# EAGLE board Resistor_Resistor (EAGLE 8.3.0), part 13 of 32
## Placement (x,y rotation side) (continued)
R15499  10K  [0201]  119.23,61.01 0 top
R15500  10K  [0201]  119.23,61.62 0 top
R15501  10K  [0201]  119.23,62.23 0 top
R15502  10K  [0201]  119.23,62.84 0 top
R15503  10K  [0201]  119.23,63.45 0 top
R15504  10K  [0201]  119.23,64.06 0 top
R15505  10K  [0201]  119.23,64.67 0 top
R15506  10K  [0201]  119.23,65.28 0 top
R15507  10K  [0201]  119.23,65.89 0 top
R15508  10K  [0201]  119.23,66.5 0 top
R15509  10K  [0201]  119.23,67.11 0 top
R15510  10K  [0201]  119.23,67.72 0 top
R15511  10K  [0201]  119.23,68.33 0 top
R15512  10K  [0201]  119.23,68.94 0 top
R15513  10K  [0201]  119.23,69.55 0 top
R15514  10K  [0201]  119.23,70.15 0 top
R15515  10K  [0201]  119.23,70.76 0 top
R15516  10K  [0201]  119.23,71.37 0 top
R15517  10K  [0201]  119.23,71.98 0 top
R15518  10K  [0201]  119.23,72.59 0 top
R15519  10K  [0201]  119.23,73.2 0 top
R15520  10K  [0201]  119.23,73.81 0 top
R15521  10K  [0201]  119.23,74.42 0 top
R15522  10K  [0201]  119.23,75.03 0 top
R15523  10K  [0201]  119.23,75.64 0 top
R15524  10K  [0201]  119.23,76.25 0 top
R15525  10K  [0201]  119.23,76.86 0 top
R15526  10K  [0201]  119.23,77.47 0 top
R15527  10K  [0201]  119.23,78.08 0 top
R15528  10K  [0201]  119.23,78.69 0 top
R15529  10K  [0201]  119.23,79.3 0 top
R15530  10K  [0201]  119.23,79.91 0 top
R15531  10K  [0201]  119.23,80.52 0 top
R15532  10K  [0201]  119.23,81.13 0 top
R15533  10K  [0201]  119.23,81.74 0 top
R15534  10K  [0201]  119.23,82.35 0 top
R15535  10K  [0201]  119.23,82.96 0 top
R15536  10K  [0201]  119.23,83.57 0 top
R15537  10K  [0201]  119.23,84.18 0 top
R15538  10K  [0201]  119.23,84.79 0 top
R15539  10K  [0201]  119.23,85.39 0 top
R15540  10K  [0201]  119.23,86 0 top
R15541  10K  [0201]  119.23,86.61 0 top
R15542  10K  [0201]  119.23,87.22 0 top
R15543  10K  [0201]  119.23,87.83 0 top
R15544  10K  [0201]  119.23,88.44 0 top
R15545  10K  [0201]  119.23,89.05 0 top
R15546  10K  [0201]  119.23,89.66 0 top
R15547  10K  [0201]  119.23,90.27 0 top
R15548  10K  [0201]  119.23,90.88 0 top
R15549  10K  [0201]  119.23,91.49 0 top
R15550  10K  [0201]  119.23,92.1 0 top
R15551  10K  [0201]  119.23,92.71 0 top
R15552  10K  [0201]  119.23,93.32 0 top
R15553  10K  [0201]  119.23,93.93 0 top
R15554  10K  [0201]  119.23,94.54 0 top
R15555  10K  [0201]  119.23,95.15 0 top
R15556  10K  [0201]  119.23,95.76 0 top
R15557  10K  [0201]  119.23,96.37 0 top
R15558  10K  [0201]  119.23,96.98 0 top
R15559  10K  [0201]  119.23,97.59 0 top
R15560  10K  [0201]  119.23,98.2 0 top
R15561  10K  [0201]  119.23,98.81 0 top
R15562  10K  [0201]  119.23,99.42 0 top
R15563  10K  [0201]  119.23,100.03 0 top
R15564  10K  [0201]  119.23,100.63 0 top
R15565  10K  [0201]  119.23,101.24 0 top
R15566  10K  [0201]  119.23,101.85 0 top
R15567  10K  [0201]  119.23,102.46 0 top
R15568  10K  [0201]  119.23,103.07 0 top
R15569  10K  [0201]  119.23,103.68 0 top
R15570  10K  [0201]  119.23,104.29 0 top
R15571  10K  [0201]  119.23,104.9 0 top
R15572  10K  [0201]  119.23,105.51 0 top
R15573  10K  [0201]  119.23,106.12 0 top
R15574  10K  [0201]  119.23,106.73 0 top
R15575  10K  [0201]  119.23,107.34 0 top
R15576  10K  [0201]  119.23,107.95 0 top
R15577  10K  [0201]  119.23,108.56 0 top
R15578  10K  [0201]  119.23,109.17 0 top
R15579  10K  [0201]  119.23,109.78 0 top
R15580  10K  [0201]  119.23,110.39 0 top
R15581  10K  [0201]  119.23,111 0 top
R15582  10K  [0201]  119.23,111.61 0 top
R15583  10K  [0201]  119.23,112.22 0 top
R15584  10K  [0201]  119.23,112.83 0 top
R15585  10K  [0201]  119.23,113.44 0 top
R15586  10K  [0201]  119.23,114.05 0 top
R15587  10K  [0201]  119.23,114.66 0 top
R15588  10K  [0201]  119.23,115.27 0 top
R15589  10K  [0201]  119.23,115.87 0 top
R15590  10K  [0201]  119.23,116.48 0 top
R15591  10K  [0201]  119.23,117.09 0 top
R15592  10K  [0201]  119.23,117.7 0 top
R15593  10K  [0201]  119.23,118.31 0 top
R15594  10K  [0201]  119.23,118.92 0 top
R15595  10K  [0201]  119.23,119.53 0 top
R15596  10K  [0201]  119.23,120.14 0 top
R15597  10K  [0201]  119.23,120.75 0 top
R15598  10K  [0201]  119.23,121.36 0 top
R15599  10K  [0201]  119.23,121.97 0 top
R15600  10K  [0201]  119.23,122.58 0 top
R15601  10K  [0201]  120.45,1.27 0 top
R15602  10K  [0201]  120.45,1.88 0 top
R15603  10K  [0201]  120.45,2.49 0 top
R15604  10K  [0201]  120.45,3.1 0 top
R15605  10K  [0201]  120.45,3.71 0 top
R15606  10K  [0201]  120.45,4.32 0 top
R15607  10K  [0201]  120.45,4.93 0 top
R15608  10K  [0201]  120.45,5.54 0 top
R15609  10K  [0201]  120.45,6.15 0 top
R15610  10K  [0201]  120.45,6.76 0 top
R15611  10K  [0201]  120.45,7.37 0 top
R15612  10K  [0201]  120.45,7.98 0 top
R15613  10K  [0201]  120.45,8.59 0 top
R15614  10K  [0201]  120.45,9.19 0 top
R15615  10K  [0201]  120.45,9.8 0 top
R15616  10K  [0201]  120.45,10.41 0 top
R15617  10K  [0201]  120.45,11.02 0 top
R15618  10K  [0201]  120.45,11.63 0 top
R15619  10K  [0201]  120.45,12.24 0 top
R15620  10K  [0201]  120.45,12.85 0 top
R15621  10K  [0201]  120.45,13.46 0 top
R15622  10K  [0201]  120.45,14.07 0 top
R15623  10K  [0201]  120.45,14.68 0 top
R15624  10K  [0201]  120.45,15.29 0 top
R15625  10K  [0201]  120.45,15.9 0 top
R15626  10K  [0201]  120.45,16.51 0 top
R15627  10K  [0201]  120.45,17.12 0 top
R15628  10K  [0201]  120.45,17.73 0 top
R15629  10K  [0201]  120.45,18.34 0 top
R15630  10K  [0201]  120.45,18.95 0 top
R15631  10K  [0201]  120.45,19.56 0 top
R15632  10K  [0201]  120.45,20.17 0 top
R15633  10K  [0201]  120.45,20.78 0 top
R15634  10K  [0201]  120.45,21.39 0 top
R15635  10K  [0201]  120.45,22 0 top
R15636  10K  [0201]  120.45,22.61 0 top
R15637  10K  [0201]  120.45,23.22 0 top
R15638  10K  [0201]  120.45,23.83 0 top
R15639  10K  [0201]  120.45,24.43 0 top
R15640  10K  [0201]  120.45,25.04 0 top
R15641  10K  [0201]  120.45,25.65 0 top
R15642  10K  [0201]  120.45,26.26 0 top
R15643  10K  [0201]  120.45,26.87 0 top
R15644  10K  [0201]  120.45,27.48 0 top
R15645  10K  [0201]  120.45,28.09 0 top
R15646  10K  [0201]  120.45,28.7 0 top
R15647  10K  [0201]  120.45,29.31 0 top
R15648  10K  [0201]  120.45,29.92 0 top
R15649  10K  [0201]  120.45,30.53 0 top
R15650  10K  [0201]  120.45,31.14 0 top
R15651  10K  [0201]  120.45,31.75 0 top
R15652  10K  [0201]  120.45,32.36 0 top
R15653  10K  [0201]  120.45,32.97 0 top
R15654  10K  [0201]  120.45,33.58 0 top
R15655  10K  [0201]  120.45,34.19 0 top
R15656  10K  [0201]  120.45,34.8 0 top
R15657  10K  [0201]  120.45,35.41 0 top
R15658  10K  [0201]  120.45,36.02 0 top
R15659  10K  [0201]  120.45,36.63 0 top
R15660  10K  [0201]  120.45,37.24 0 top
R15661  10K  [0201]  120.45,37.85 0 top
R15662  10K  [0201]  120.45,38.46 0 top
R15663  10K  [0201]  120.45,39.07 0 top
R15664  10K  [0201]  120.45,39.67 0 top
R15665  10K  [0201]  120.45,40.28 0 top
R15666  10K  [0201]  120.45,40.89 0 top
R15667  10K  [0201]  120.45,41.5 0 top
R15668  10K  [0201]  120.45,42.11 0 top
R15669  10K  [0201]  120.45,42.72 0 top
R15670  10K  [0201]  120.45,43.33 0 top
R15671  10K  [0201]  120.45,43.94 0 top
R15672  10K  [0201]  120.45,44.55 0 top
R15673  10K  [0201]  120.45,45.16 0 top
R15674  10K  [0201]  120.45,45.77 0 top
R15675  10K  [0201]  120.45,46.38 0 top
R15676  10K  [0201]  120.45,46.99 0 top
R15677  10K  [0201]  120.45,47.6 0 top
R15678  10K  [0201]  120.45,48.21 0 top
R15679  10K  [0201]  120.45,48.82 0 top
R15680  10K  [0201]  120.45,49.43 0 top
R15681  10K  [0201]  120.45,50.04 0 top
R15682  10K  [0201]  120.45,50.65 0 top
R15683  10K  [0201]  120.45,51.26 0 top
R15684  10K  [0201]  120.45,51.87 0 top
R15685  10K  [0201]  120.45,52.48 0 top
R15686  10K  [0201]  120.45,53.09 0 top
R15687  10K  [0201]  120.45,53.7 0 top
R15688  10K  [0201]  120.45,54.31 0 top
R15689  10K  [0201]  120.45,54.91 0 top
R15690  10K  [0201]  120.45,55.52 0 top
R15691  10K  [0201]  120.45,56.13 0 top
R15692  10K  [0201]  120.45,56.74 0 top
R15693  10K  [0201]  120.45,57.35 0 top
R15694  10K  [0201]  120.45,57.96 0 top
R15695  10K  [0201]  120.45,58.57 0 top
R15696  10K  [0201]  120.45,59.18 0 top
R15697  10K  [0201]  120.45,59.79 0 top
R15698  10K  [0201]  120.45,60.4 0 top
R15699  10K  [0201]  120.45,61.01 0 top
R15700  10K  [0201]  120.45,61.62 0 top
R15701  10K  [0201]  120.45,62.23 0 top
R15702  10K  [0201]  120.45,62.84 0 top
R15703  10K  [0201]  120.45,63.45 0 top
R15704  10K  [0201]  120.45,64.06 0 top
R15705  10K  [0201]  120.45,64.67 0 top
R15706  10K  [0201]  120.45,65.28 0 top
R15707  10K  [0201]  120.45,65.89 0 top
R15708  10K  [0201]  120.45,66.5 0 top
R15709  10K  [0201]  120.45,67.11 0 top
R15710  10K  [0201]  120.45,67.72 0 top
R15711  10K  [0201]  120.45,68.33 0 top
R15712  10K  [0201]  120.45,68.94 0 top
R15713  10K  [0201]  120.45,69.55 0 top
R15714  10K  [0201]  120.45,70.15 0 top
R15715  10K  [0201]  120.45,70.76 0 top
R15716  10K  [0201]  120.45,71.37 0 top
R15717  10K  [0201]  120.45,71.98 0 top
R15718  10K  [0201]  120.45,72.59 0 top
R15719  10K  [0201]  120.45,73.2 0 top
R15720  10K  [0201]  120.45,73.81 0 top
R15721  10K  [0201]  120.45,74.42 0 top
R15722  10K  [0201]  120.45,75.03 0 top
R15723  10K  [0201]  120.45,75.64 0 top
R15724  10K  [0201]  120.45,76.25 0 top
R15725  10K  [0201]  120.45,76.86 0 top
R15726  10K  [0201]  120.45,77.47 0 top
R15727  10K  [0201]  120.45,78.08 0 top
R15728  10K  [0201]  120.45,78.69 0 top
R15729  10K  [0201]  120.45,79.3 0 top
R15730  10K  [0201]  120.45,79.91 0 top
R15731  10K  [0201]  120.45,80.52 0 top
R15732  10K  [0201]  120.45,81.13 0 top
R15733  10K  [0201]  120.45,81.74 0 top
R15734  10K  [0201]  120.45,82.35 0 top
R15735  10K  [0201]  120.45,82.96 0 top
R15736  10K  [0201]  120.45,83.57 0 top
R15737  10K  [0201]  120.45,84.18 0 top
R15738  10K  [0201]  120.45,84.79 0 top
R15739  10K  [0201]  120.45,85.39 0 top
R15740  10K  [0201]  120.45,86 0 top
R15741  10K  [0201]  120.45,86.61 0 top
R15742  10K  [0201]  120.45,87.22 0 top
R15743  10K  [0201]  120.45,87.83 0 top
R15744  10K  [0201]  120.45,88.44 0 top
R15745  10K  [0201]  120.45,89.05 0 top
R15746  10K  [0201]  120.45,89.66 0 top
R15747  10K  [0201]  120.45,90.27 0 top
R15748  10K  [0201]  120.45,90.88 0 top
R15749  10K  [0201]  120.45,91.49 0 top
R15750  10K  [0201]  120.45,92.1 0 top
R15751  10K  [0201]  120.45,92.71 0 top
R15752  10K  [0201]  120.45,93.32 0 top
R15753  10K  [0201]  120.45,93.93 0 top
R15754  10K  [0201]  120.45,94.54 0 top
R15755  10K  [0201]  120.45,95.15 0 top
R15756  10K  [0201]  120.45,95.76 0 top
R15757  10K  [0201]  120.45,96.37 0 top
R15758  10K  [0201]  120.45,96.98 0 top
R15759  10K  [0201]  120.45,97.59 0 top
R15760  10K  [0201]  120.45,98.2 0 top
R15761  10K  [0201]  120.45,98.81 0 top
R15762  10K  [0201]  120.45,99.42 0 top
R15763  10K  [0201]  120.45,100.03 0 top
R15764  10K  [0201]  120.45,100.63 0 top
R15765  10K  [0201]  120.45,101.24 0 top
R15766  10K  [0201]  120.45,101.85 0 top
R15767  10K  [0201]  120.45,102.46 0 top
R15768  10K  [0201]  120.45,103.07 0 top
R15769  10K  [0201]  120.45,103.68 0 top
R15770  10K  [0201]  120.45,104.29 0 top
R15771  10K  [0201]  120.45,104.9 0 top
R15772  10K  [0201]  120.45,105.51 0 top
R15773  10K  [0201]  120.45,106.12 0 top
R15774  10K  [0201]  120.45,106.73 0 top
R15775  10K  [0201]  120.45,107.34 0 top
R15776  10K  [0201]  120.45,107.95 0 top
R15777  10K  [0201]  120.45,108.56 0 top
R15778  10K  [0201]  120.45,109.17 0 top
R15779  10K  [0201]  120.45,109.78 0 top
R15780  10K  [0201]  120.45,110.39 0 top
R15781  10K  [0201]  120.45,111 0 top
R15782  10K  [0201]  120.45,111.61 0 top
R15783  10K  [0201]  120.45,112.22 0 top
R15784  10K  [0201]  120.45,112.83 0 top
R15785  10K  [0201]  120.45,113.44 0 top
R15786  10K  [0201]  120.45,114.05 0 top
R15787  10K  [0201]  120.45,114.66 0 top
R15788  10K  [0201]  120.45,115.27 0 top
R15789  10K  [0201]  120.45,115.87 0 top
R15790  10K  [0201]  120.45,116.48 0 top
R15791  10K  [0201]  120.45,117.09 0 top
R15792  10K  [0201]  120.45,117.7 0 top
R15793  10K  [0201]  120.45,118.31 0 top
R15794  10K  [0201]  120.45,118.92 0 top
R15795  10K  [0201]  120.45,119.53 0 top
R15796  10K  [0201]  120.45,120.14 0 top
R15797  10K  [0201]  120.45,120.75 0 top
R15798  10K  [0201]  120.45,121.36 0 top
R15799  10K  [0201]  120.45,121.97 0 top
R15800  10K  [0201]  120.45,122.58 0 top
R15801  10K  [0201]  121.67,1.27 0 top
R15802  10K  [0201]  121.67,1.88 0 top
R15803  10K  [0201]  121.67,2.49 0 top
R15804  10K  [0201]  121.67,3.1 0 top
R15805  10K  [0201]  121.67,3.71 0 top
R15806  10K  [0201]  121.67,4.32 0 top
R15807  10K  [0201]  121.67,4.93 0 top
R15808  10K  [0201]  121.67,5.54 0 top
R15809  10K  [0201]  121.67,6.15 0 top
R15810  10K  [0201]  121.67,6.76 0 top
R15811  10K  [0201]  121.67,7.37 0 top
R15812  10K  [0201]  121.67,7.98 0 top
R15813  10K  [0201]  121.67,8.59 0 top
R15814  10K  [0201]  121.67,9.19 0 top
R15815  10K  [0201]  121.67,9.8 0 top
R15816  10K  [0201]  121.67,10.41 0 top
R15817  10K  [0201]  121.67,11.02 0 top
R15818  10K  [0201]  121.67,11.63 0 top
R15819  10K  [0201]  121.67,12.24 0 top
R15820  10K  [0201]  121.67,12.85 0 top
R15821  10K  [0201]  121.67,13.46 0 top
R15822  10K  [0201]  121.67,14.07 0 top
R15823  10K  [0201]  121.67,14.68 0 top
R15824  10K  [0201]  121.67,15.29 0 top
R15825  10K  [0201]  121.67,15.9 0 top
R15826  10K  [0201]  121.67,16.51 0 top
R15827  10K  [0201]  121.67,17.12 0 top
R15828  10K  [0201]  121.67,17.73 0 top
R15829  10K  [0201]  121.67,18.34 0 top
R15830  10K  [0201]  121.67,18.95 0 top
R15831  10K  [0201]  121.67,19.56 0 top
R15832  10K  [0201]  121.67,20.17 0 top
R15833  10K  [0201]  121.67,20.78 0 top
R15834  10K  [0201]  121.67,21.39 0 top
R15835  10K  [0201]  121.67,22 0 top
R15836  10K  [0201]  121.67,22.61 0 top
R15837  10K  [0201]  121.67,23.22 0 top
R15838  10K  [0201]  121.67,23.83 0 top
R15839  10K  [0201]  121.67,24.43 0 top
R15840  10K  [0201]  121.67,25.04 0 top
R15841  10K  [0201]  121.67,25.65 0 top
R15842  10K  [0201]  121.67,26.26 0 top
R15843  10K  [0201]  121.67,26.87 0 top
R15844  10K  [0201]  121.67,27.48 0 top
R15845  10K  [0201]  121.67,28.09 0 top
R15846  10K  [0201]  121.67,28.7 0 top
R15847  10K  [0201]  121.67,29.31 0 top
R15848  10K  [0201]  121.67,29.92 0 top
R15849  10K  [0201]  121.67,30.53 0 top
R15850  10K  [0201]  121.67,31.14 0 top
R15851  10K  [0201]  121.67,31.75 0 top
R15852  10K  [0201]  121.67,32.36 0 top
R15853  10K  [0201]  121.67,32.97 0 top
R15854  10K  [0201]  121.67,33.58 0 top
R15855  10K  [0201]  121.67,34.19 0 top
R15856  10K  [0201]  121.67,34.8 0 top
R15857  10K  [0201]  121.67,35.41 0 top
R15858  10K  [0201]  121.67,36.02 0 top
R15859  10K  [0201]  121.67,36.63 0 top
R15860  10K  [0201]  121.67,37.24 0 top
R15861  10K  [0201]  121.67,37.85 0 top
R15862  10K  [0201]  121.67,38.46 0 top
R15863  10K  [0201]  121.67,39.07 0 top
R15864  10K  [0201]  121.67,39.67 0 top
R15865  10K  [0201]  121.67,40.28 0 top
R15866  10K  [0201]  121.67,40.89 0 top
R15867  10K  [0201]  121.67,41.5 0 top
R15868  10K  [0201]  121.67,42.11 0 top
R15869  10K  [0201]  121.67,42.72 0 top
R15870  10K  [0201]  121.67,43.33 0 top
R15871  10K  [0201]  121.67,43.94 0 top
R15872  10K  [0201]  121.67,44.55 0 top
R15873  10K  [0201]  121.67,45.16 0 top
R15874  10K  [0201]  121.67,45.77 0 top
R15875  10K  [0201]  121.67,46.38 0 top
R15876  10K  [0201]  121.67,46.99 0 top
R15877  10K  [0201]  121.67,47.6 0 top
R15878  10K  [0201]  121.67,48.21 0 top
R15879  10K  [0201]  121.67,48.82 0 top
R15880  10K  [0201]  121.67,49.43 0 top
R15881  10K  [0201]  121.67,50.04 0 top
R15882  10K  [0201]  121.67,50.65 0 top
R15883  10K  [0201]  121.67,51.26 0 top
R15884  10K  [0201]  121.67,51.87 0 top
R15885  10K  [0201]  121.67,52.48 0 top
R15886  10K  [0201]  121.67,53.09 0 top
R15887  10K  [0201]  121.67,53.7 0 top
R15888  10K  [0201]  121.67,54.31 0 top
R15889  10K  [0201]  121.67,54.91 0 top
R15890  10K  [0201]  121.67,55.52 0 top
R15891  10K  [0201]  121.67,56.13 0 top
R15892  10K  [0201]  121.67,56.74 0 top
R15893  10K  [0201]  121.67,57.35 0 top
R15894  10K  [0201]  121.67,57.96 0 top
R15895  10K  [0201]  121.67,58.57 0 top
R15896  10K  [0201]  121.67,59.18 0 top
R15897  10K  [0201]  121.67,59.79 0 top
R15898  10K  [0201]  121.67,60.4 0 top
R15899  10K  [0201]  121.67,61.01 0 top
R15900  10K  [0201]  121.67,61.62 0 top
R15901  10K  [0201]  121.67,62.23 0 top
R15902  10K  [0201]  121.67,62.84 0 top
R15903  10K  [0201]  121.67,63.45 0 top
R15904  10K  [0201]  121.67,64.06 0 top
R15905  10K  [0201]  121.67,64.67 0 top
R15906  10K  [0201]  121.67,65.28 0 top
R15907  10K  [0201]  121.67,65.89 0 top
R15908  10K  [0201]  121.67,66.5 0 top
R15909  10K  [0201]  121.67,67.11 0 top
R15910  10K  [0201]  121.67,67.72 0 top
R15911  10K  [0201]  121.67,68.33 0 top
R15912  10K  [0201]  121.67,68.94 0 top
R15913  10K  [0201]  121.67,69.55 0 top
R15914  10K  [0201]  121.67,70.15 0 top
R15915  10K  [0201]  121.67,70.76 0 top
R15916  10K  [0201]  121.67,71.37 0 top
R15917  10K  [0201]  121.67,71.98 0 top
R15918  10K  [0201]  121.67,72.59 0 top
R15919  10K  [0201]  121.67,73.2 0 top
R15920  10K  [0201]  121.67,73.81 0 top
R15921  10K  [0201]  121.67,74.42 0 top
R15922  10K  [0201]  121.67,75.03 0 top
R15923  10K  [0201]  121.67,75.64 0 top
R15924  10K  [0201]  121.67,76.25 0 top
R15925  10K  [0201]  121.67,76.86 0 top
R15926  10K  [0201]  121.67,77.47 0 top
R15927  10K  [0201]  121.67,78.08 0 top
R15928  10K  [0201]  121.67,78.69 0 top
R15929  10K  [0201]  121.67,79.3 0 top
R15930  10K  [0201]  121.67,79.91 0 top
R15931  10K  [0201]  121.67,80.52 0 top
R15932  10K  [0201]  121.67,81.13 0 top
R15933  10K  [0201]  121.67,81.74 0 top
R15934  10K  [0201]  121.67,82.35 0 top
R15935  10K  [0201]  121.67,82.96 0 top
R15936  10K  [0201]  121.67,83.57 0 top
R15937  10K  [0201]  121.67,84.18 0 top
R15938  10K  [0201]  121.67,84.79 0 top
R15939  10K  [0201]  121.67,85.39 0 top
R15940  10K  [0201]  121.67,86 0 top
R15941  10K  [0201]  121.67,86.61 0 top
R15942  10K  [0201]  121.67,87.22 0 top
R15943  10K  [0201]  121.67,87.83 0 top
R15944  10K  [0201]  121.67,88.44 0 top
R15945  10K  [0201]  121.67,89.05 0 top
R15946  10K  [0201]  121.67,89.66 0 top
R15947  10K  [0201]  121.67,90.27 0 top
R15948  10K  [0201]  121.67,90.88 0 top
R15949  10K  [0201]  121.67,91.49 0 top
R15950  10K  [0201]  121.67,92.1 0 top
R15951  10K  [0201]  121.67,92.71 0 top
R15952  10K  [0201]  121.67,93.32 0 top
R15953  10K  [0201]  121.67,93.93 0 top
R15954  10K  [0201]  121.67,94.54 0 top
R15955  10K  [0201]  121.67,95.15 0 top
R15956  10K  [0201]  121.67,95.76 0 top
R15957  10K  [0201]  121.67,96.37 0 top
R15958  10K  [0201]  121.67,96.98 0 top
R15959  10K  [0201]  121.67,97.59 0 top
R15960  10K  [0201]  121.67,98.2 0 top
R15961  10K  [0201]  121.67,98.81 0 top
R15962  10K  [0201]  121.67,99.42 0 top
R15963  10K  [0201]  121.67,100.03 0 top
R15964  10K  [0201]  121.67,100.63 0 top
R15965  10K  [0201]  121.67,101.24 0 top
R15966  10K  [0201]  121.67,101.85 0 top
R15967  10K  [0201]  121.67,102.46 0 top
R15968  10K  [0201]  121.67,103.07 0 top
R15969  10K  [0201]  121.67,103.68 0 top
R15970  10K  [0201]  121.67,104.29 0 top
R15971  10K  [0201]  121.67,104.9 0 top
R15972  10K  [0201]  121.67,105.51 0 top
R15973  10K  [0201]  121.67,106.12 0 top
R15974  10K  [0201]  121.67,106.73 0 top
R15975  10K  [0201]  121.67,107.34 0 top
R15976  10K  [0201]  121.67,107.95 0 top
R15977  10K  [0201]  121.67,108.56 0 top
R15978  10K  [0201]  121.67,109.17 0 top
R15979  10K  [0201]  121.67,109.78 0 top
R15980  10K  [0201]  121.67,110.39 0 top
R15981  10K  [0201]  121.67,111 0 top
R15982  10K  [0201]  121.67,111.61 0 top
R15983  10K  [0201]  121.67,112.22 0 top
R15984  10K  [0201]  121.67,112.83 0 top
R15985  10K  [0201]  121.67,113.44 0 top
R15986  10K  [0201]  121.67,114.05 0 top
R15987  10K  [0201]  121.67,114.66 0 top
R15988  10K  [0201]  121.67,115.27 0 top
R15989  10K  [0201]  121.67,115.87 0 top
R15990  10K  [0201]  121.67,116.48 0 top
R15991  10K  [0201]  121.67,117.09 0 top
R15992  10K  [0201]  121.67,117.7 0 top
R15993  10K  [0201]  121.67,118.31 0 top
R15994  10K  [0201]  121.67,118.92 0 top
R15995  10K  [0201]  121.67,119.53 0 top
R15996  10K  [0201]  121.67,120.14 0 top
R15997  10K  [0201]  121.67,120.75 0 top
R15998  10K  [0201]  121.67,121.36 0 top
R15999  10K  [0201]  121.67,121.97 0 top
R16000  10K  [0201]  121.67,122.58 0 top
R16001  10K  [0201]  122.89,1.27 0 top
R16002  10K  [0201]  122.89,1.88 0 top
R16003  10K  [0201]  122.89,2.49 0 top
R16004  10K  [0201]  122.89,3.1 0 top
R16005  10K  [0201]  122.89,3.71 0 top
R16006  10K  [0201]  122.89,4.32 0 top
R16007  10K  [0201]  122.89,4.93 0 top
R16008  10K  [0201]  122.89,5.54 0 top
R16009  10K  [0201]  122.89,6.15 0 top
R16010  10K  [0201]  122.89,6.76 0 top
R16011  10K  [0201]  122.89,7.37 0 top
R16012  10K  [0201]  122.89,7.98 0 top
R16013  10K  [0201]  122.89,8.59 0 top
R16014  10K  [0201]  122.89,9.19 0 top
R16015  10K  [0201]  122.89,9.8 0 top
R16016  10K  [0201]  122.89,10.41 0 top
R16017  10K  [0201]  122.89,11.02 0 top
R16018  10K  [0201]  122.89,11.63 0 top
R16019  10K  [0201]  122.89,12.24 0 top
R16020  10K  [0201]  122.89,12.85 0 top
R16021  10K  [0201]  122.89,13.46 0 top
R16022  10K  [0201]  122.89,14.07 0 top
R16023  10K  [0201]  122.89,14.68 0 top
R16024  10K  [0201]  122.89,15.29 0 top
R16025  10K  [0201]  122.89,15.9 0 top
R16026  10K  [0201]  122.89,16.51 0 top
R16027  10K  [0201]  122.89,17.12 0 top
R16028  10K  [0201]  122.89,17.73 0 top
R16029  10K  [0201]  122.89,18.34 0 top
R16030  10K  [0201]  122.89,18.95 0 top
R16031  10K  [0201]  122.89,19.56 0 top
R16032  10K  [0201]  122.89,20.17 0 top
R16033  10K  [0201]  122.89,20.78 0 top
R16034  10K  [0201]  122.89,21.39 0 top
R16035  10K  [0201]  122.89,22 0 top
R16036  10K  [0201]  122.89,22.61 0 top
R16037  10K  [0201]  122.89,23.22 0 top
R16038  10K  [0201]  122.89,23.83 0 top
R16039  10K  [0201]  122.89,24.43 0 top
R16040  10K  [0201]  122.89,25.04 0 top
R16041  10K  [0201]  122.89,25.65 0 top
R16042  10K  [0201]  122.89,26.26 0 top
R16043  10K  [0201]  122.89,26.87 0 top
R16044  10K  [0201]  122.89,27.48 0 top
R16045  10K  [0201]  122.89,28.09 0 top
R16046  10K  [0201]  122.89,28.7 0 top
R16047  10K  [0201]  122.89,29.31 0 top
R16048  10K  [0201]  122.89,29.92 0 top
R16049  10K  [0201]  122.89,30.53 0 top
R16050  10K  [0201]  122.89,31.14 0 top
R16051  10K  [0201]  122.89,31.75 0 top
R16052  10K  [0201]  122.89,32.36 0 top
R16053  10K  [0201]  122.89,32.97 0 top
R16054  10K  [0201]  122.89,33.58 0 top
R16055  10K  [0201]  122.89,34.19 0 top
R16056  10K  [0201]  122.89,34.8 0 top
R16057  10K  [0201]  122.89,35.41 0 top
R16058  10K  [0201]  122.89,36.02 0 top
R16059  10K  [0201]  122.89,36.63 0 top
R16060  10K  [0201]  122.89,37.24 0 top
R16061  10K  [0201]  122.89,37.85 0 top
R16062  10K  [0201]  122.89,38.46 0 top
R16063  10K  [0201]  122.89,39.07 0 top
R16064  10K  [0201]  122.89,39.67 0 top
R16065  10K  [0201]  122.89,40.28 0 top
R16066  10K  [0201]  122.89,40.89 0 top
R16067  10K  [0201]  122.89,41.5 0 top
R16068  10K  [0201]  122.89,42.11 0 top
R16069  10K  [0201]  122.89,42.72 0 top
R16070  10K  [0201]  122.89,43.33 0 top
R16071  10K  [0201]  122.89,43.94 0 top
R16072  10K  [0201]  122.89,44.55 0 top
R16073  10K  [0201]  122.89,45.16 0 top
R16074  10K  [0201]  122.89,45.77 0 top
R16075  10K  [0201]  122.89,46.38 0 top
R16076  10K  [0201]  122.89,46.99 0 top
R16077  10K  [0201]  122.89,47.6 0 top
R16078  10K  [0201]  122.89,48.21 0 top
R16079  10K  [0201]  122.89,48.82 0 top
R16080  10K  [0201]  122.89,49.43 0 top
R16081  10K  [0201]  122.89,50.04 0 top
R16082  10K  [0201]  122.89,50.65 0 top
R16083  10K  [0201]  122.89,51.26 0 top
R16084  10K  [0201]  122.89,51.87 0 top
R16085  10K  [0201]  122.89,52.48 0 top
R16086  10K  [0201]  122.89,53.09 0 top
R16087  10K  [0201]  122.89,53.7 0 top
R16088  10K  [0201]  122.89,54.31 0 top
R16089  10K  [0201]  122.89,54.91 0 top
R16090  10K  [0201]  122.89,55.52 0 top
R16091  10K  [0201]  122.89,56.13 0 top
R16092  10K  [0201]  122.89,56.74 0 top
R16093  10K  [0201]  122.89,57.35 0 top
R16094  10K  [0201]  122.89,57.96 0 top
R16095  10K  [0201]  122.89,58.57 0 top
R16096  10K  [0201]  122.89,59.18 0 top
R16097  10K  [0201]  122.89,59.79 0 top
R16098  10K  [0201]  122.89,60.4 0 top
R16099  10K  [0201]  122.89,61.01 0 top
R16100  10K  [0201]  122.89,61.62 0 top
R16101  10K  [0201]  122.89,62.23 0 top
R16102  10K  [0201]  122.89,62.84 0 top
R16103  10K  [0201]  122.89,63.45 0 top
R16104  10K  [0201]  122.89,64.06 0 top
R16105  10K  [0201]  122.89,64.67 0 top
R16106  10K  [0201]  122.89,65.28 0 top
R16107  10K  [0201]  122.89,65.89 0 top
R16108  10K  [0201]  122.89,66.5 0 top
R16109  10K  [0201]  122.89,67.11 0 top
R16110  10K  [0201]  122.89,67.72 0 top
R16111  10K  [0201]  122.89,68.33 0 top
R16112  10K  [0201]  122.89,68.94 0 top
R16113  10K  [0201]  122.89,69.55 0 top
R16114  10K  [0201]  122.89,70.15 0 top
R16115  10K  [0201]  122.89,70.76 0 top
R16116  10K  [0201]  122.89,71.37 0 top
R16117  10K  [0201]  122.89,71.98 0 top
R16118  10K  [0201]  122.89,72.59 0 top
R16119  10K  [0201]  122.89,73.2 0 top
R16120  10K  [0201]  122.89,73.81 0 top
R16121  10K  [0201]  122.89,74.42 0 top
R16122  10K  [0201]  122.89,75.03 0 top
R16123  10K  [0201]  122.89,75.64 0 top
R16124  10K  [0201]  122.89,76.25 0 top
R16125  10K  [0201]  122.89,76.86 0 top
R16126  10K  [0201]  122.89,77.47 0 top
R16127  10K  [0201]  122.89,78.08 0 top
R16128  10K  [0201]  122.89,78.69 0 top
R16129  10K  [0201]  122.89,79.3 0 top
R16130  10K  [0201]  122.89,79.91 0 top
R16131  10K  [0201]  122.89,80.52 0 top
R16132  10K  [0201]  122.89,81.13 0 top
R16133  10K  [0201]  122.89,81.74 0 top
R16134  10K  [0201]  122.89,82.35 0 top
R16135  10K  [0201]  122.89,82.96 0 top
R16136  10K  [0201]  122.89,83.57 0 top
R16137  10K  [0201]  122.89,84.18 0 top
R16138  10K  [0201]  122.89,84.79 0 top
R16139  10K  [0201]  122.89,85.39 0 top
R16140  10K  [0201]  122.89,86 0 top
R16141  10K  [0201]  122.89,86.61 0 top
R16142  10K  [0201]  122.89,87.22 0 top
R16143  10K  [0201]  122.89,87.83 0 top
R16144  10K  [0201]  122.89,88.44 0 top
R16145  10K  [0201]  122.89,89.05 0 top
R16146  10K  [0201]  122.89,89.66 0 top
R16147  10K  [0201]  122.89,90.27 0 top
R16148  10K  [0201]  122.89,90.88 0 top
R16149  10K  [0201]  122.89,91.49 0 top
R16150  10K  [0201]  122.89,92.1 0 top
R16151  10K  [0201]  122.89,92.71 0 top
R16152  10K  [0201]  122.89,93.32 0 top
R16153  10K  [0201]  122.89,93.93 0 top
R16154  10K  [0201]  122.89,94.54 0 top
R16155  10K  [0201]  122.89,95.15 0 top
R16156  10K  [0201]  122.89,95.76 0 top
R16157  10K  [0201]  122.89,96.37 0 top
R16158  10K  [0201]  122.89,96.98 0 top
R16159  10K  [0201]  122.89,97.59 0 top
R16160  10K  [0201]  122.89,98.2 0 top
R16161  10K  [0201]  122.89,98.81 0 top
R16162  10K  [0201]  122.89,99.42 0 top
R16163  10K  [0201]  122.89,100.03 0 top
R16164  10K  [0201]  122.89,100.63 0 top
R16165  10K  [0201]  122.89,101.24 0 top
R16166  10K  [0201]  122.89,101.85 0 top
R16167  10K  [0201]  122.89,102.46 0 top
R16168  10K  [0201]  122.89,103.07 0 top
R16169  10K  [0201]  122.89,103.68 0 top
R16170  10K  [0201]  122.89,104.29 0 top
R16171  10K  [0201]  122.89,104.9 0 top
R16172  10K  [0201]  122.89,105.51 0 top
R16173  10K  [0201]  122.89,106.12 0 top
R16174  10K  [0201]  122.89,106.73 0 top
R16175  10K  [0201]  122.89,107.34 0 top
R16176  10K  [0201]  122.89,107.95 0 top
R16177  10K  [0201]  122.89,108.56 0 top
R16178  10K  [0201]  122.89,109.17 0 top
R16179  10K  [0201]  122.89,109.78 0 top
R16180  10K  [0201]  122.89,110.39 0 top
R16181  10K  [0201]  122.89,111 0 top
R16182  10K  [0201]  122.89,111.61 0 top
R16183  10K  [0201]  122.89,112.22 0 top
R16184  10K  [0201]  122.89,112.83 0 top
R16185  10K  [0201]  122.89,113.44 0 top
R16186  10K  [0201]  122.89,114.05 0 top
R16187  10K  [0201]  122.89,114.66 0 top
R16188  10K  [0201]  122.89,115.27 0 top
R16189  10K  [0201]  122.89,115.87 0 top
R16190  10K  [0201]  122.89,116.48 0 top
R16191  10K  [0201]  122.89,117.09 0 top
R16192  10K  [0201]  122.89,117.7 0 top
R16193  10K  [0201]  122.89,118.31 0 top
R16194  10K  [0201]  122.89,118.92 0 top
R16195  10K  [0201]  122.89,119.53 0 top
R16196  10K  [0201]  122.89,120.14 0 top
R16197  10K  [0201]  122.89,120.75 0 top
R16198  10K  [0201]  122.89,121.36 0 top
R16199  10K  [0201]  122.89,121.97 0 top
R16200  10K  [0201]  122.89,122.58 0 top
R16201  10K  [0201]  124.1,1.27 0 top
R16202  10K  [0201]  124.1,1.88 0 top
R16203  10K  [0201]  124.1,2.49 0 top
R16204  10K  [0201]  124.1,3.1 0 top
R16205  10K  [0201]  124.1,3.71 0 top
R16206  10K  [0201]  124.1,4.32 0 top
R16207  10K  [0201]  124.1,4.93 0 top
R16208  10K  [0201]  124.1,5.54 0 top
R16209  10K  [0201]  124.1,6.15 0 top
R16210  10K  [0201]  124.1,6.76 0 top
R16211  10K  [0201]  124.1,7.37 0 top
R16212  10K  [0201]  124.1,7.98 0 top
R16213  10K  [0201]  124.1,8.59 0 top
R16214  10K  [0201]  124.1,9.19 0 top
R16215  10K  [0201]  124.1,9.8 0 top
R16216  10K  [0201]  124.1,10.41 0 top
R16217  10K  [0201]  124.1,11.02 0 top
R16218  10K  [0201]  124.1,11.63 0 top
R16219  10K  [0201]  124.1,12.24 0 top
R16220  10K  [0201]  124.1,12.85 0 top
R16221  10K  [0201]  124.1,13.46 0 top
R16222  10K  [0201]  124.1,14.07 0 top
R16223  10K  [0201]  124.1,14.68 0 top
R16224  10K  [0201]  124.1,15.29 0 top
R16225  10K  [0201]  124.1,15.9 0 top
R16226  10K  [0201]  124.1,16.51 0 top
R16227  10K  [0201]  124.1,17.12 0 top
R16228  10K  [0201]  124.1,17.73 0 top
R16229  10K  [0201]  124.1,18.34 0 top
R16230  10K  [0201]  124.1,18.95 0 top
R16231  10K  [0201]  124.1,19.56 0 top
R16232  10K  [0201]  124.1,20.17 0 top
R16233  10K  [0201]  124.1,20.78 0 top
R16234  10K  [0201]  124.1,21.39 0 top
R16235  10K  [0201]  124.1,22 0 top
R16236  10K  [0201]  124.1,22.61 0 top
R16237  10K  [0201]  124.1,23.22 0 top
R16238  10K  [0201]  124.1,23.83 0 top
R16239  10K  [0201]  124.1,24.43 0 top
R16240  10K  [0201]  124.1,25.04 0 top
R16241  10K  [0201]  124.1,25.65 0 top
R16242  10K  [0201]  124.1,26.26 0 top
R16243  10K  [0201]  124.1,26.87 0 top
R16244  10K  [0201]  124.1,27.48 0 top
R16245  10K  [0201]  124.1,28.09 0 top
R16246  10K  [0201]  124.1,28.7 0 top
R16247  10K  [0201]  124.1,29.31 0 top
R16248  10K  [0201]  124.1,29.92 0 top
R16249  10K  [0201]  124.1,30.53 0 top
R16250  10K  [0201]  124.1,31.14 0 top
R16251  10K  [0201]  124.1,31.75 0 top
R16252  10K  [0201]  124.1,32.36 0 top
R16253  10K  [0201]  124.1,32.97 0 top
R16254  10K  [0201]  124.1,33.58 0 top
R16255  10K  [0201]  124.1,34.19 0 top
R16256  10K  [0201]  124.1,34.8 0 top
R16257  10K  [0201]  124.1,35.41 0 top
R16258  10K  [0201]  124.1,36.02 0 top
R16259  10K  [0201]  124.1,36.63 0 top
R16260  10K  [0201]  124.1,37.24 0 top
R16261  10K  [0201]  124.1,37.85 0 top
R16262  10K  [0201]  124.1,38.46 0 top
R16263  10K  [0201]  124.1,39.07 0 top
R16264  10K  [0201]  124.1,39.67 0 top
R16265  10K  [0201]  124.1,40.28 0 top
R16266  10K  [0201]  124.1,40.89 0 top
R16267  10K  [0201]  124.1,41.5 0 top
R16268  10K  [0201]  124.1,42.11 0 top
R16269  10K  [0201]  124.1,42.72 0 top
R16270  10K  [0201]  124.1,43.33 0 top
R16271  10K  [0201]  124.1,43.94 0 top
R16272  10K  [0201]  124.1,44.55 0 top
R16273  10K  [0201]  124.1,45.16 0 top
R16274  10K  [0201]  124.1,45.77 0 top
R16275  10K  [0201]  124.1,46.38 0 top
R16276  10K  [0201]  124.1,46.99 0 top
R16277  10K  [0201]  124.1,47.6 0 top
R16278  10K  [0201]  124.1,48.21 0 top
R16279  10K  [0201]  124.1,48.82 0 top
R16280  10K  [0201]  124.1,49.43 0 top
R16281  10K  [0201]  124.1,50.04 0 top
R16282  10K  [0201]  124.1,50.65 0 top
R16283  10K  [0201]  124.1,51.26 0 top
R16284  10K  [0201]  124.1,51.87 0 top
R16285  10K  [0201]  124.1,52.48 0 top
R16286  10K  [0201]  124.1,53.09 0 top
R16287  10K  [0201]  124.1,53.7 0 top
R16288  10K  [0201]  124.1,54.31 0 top
R16289  10K  [0201]  124.1,54.91 0 top
R16290  10K  [0201]  124.1,55.52 0 top
R16291  10K  [0201]  124.1,56.13 0 top
R16292  10K  [0201]  124.1,56.74 0 top
R16293  10K  [0201]  124.1,57.35 0 top
R16294  10K  [0201]  124.1,57.96 0 top
R16295  10K  [0201]  124.1,58.57 0 top
R16296  10K  [0201]  124.1,59.18 0 top
R16297  10K  [0201]  124.1,59.79 0 top
R16298  10K  [0201]  124.1,60.4 0 top
R16299  10K  [0201]  124.1,61.01 0 top
R16300  10K  [0201]  124.1,61.62 0 top
R16301  10K  [0201]  124.1,62.23 0 top
R16302  10K  [0201]  124.1,62.84 0 top
R16303  10K  [0201]  124.1,63.45 0 top
R16304  10K  [0201]  124.1,64.06 0 top
R16305  10K  [0201]  124.1,64.67 0 top
R16306  10K  [0201]  124.1,65.28 0 top
R16307  10K  [0201]  124.1,65.89 0 top
R16308  10K  [0201]  124.1,66.5 0 top
R16309  10K  [0201]  124.1,67.11 0 top
R16310  10K  [0201]  124.1,67.72 0 top
R16311  10K  [0201]  124.1,68.33 0 top
R16312  10K  [0201]  124.1,68.94 0 top
R16313  10K  [0201]  124.1,69.55 0 top
R16314  10K  [0201]  124.1,70.15 0 top
R16315  10K  [0201]  124.1,70.76 0 top
R16316  10K  [0201]  124.1,71.37 0 top
R16317  10K  [0201]  124.1,71.98 0 top
R16318  10K  [0201]  124.1,72.59 0 top
R16319  10K  [0201]  124.1,73.2 0 top
R16320  10K  [0201]  124.1,73.81 0 top
R16321  10K  [0201]  124.1,74.42 0 top
R16322  10K  [0201]  124.1,75.03 0 top
R16323  10K  [0201]  124.1,75.64 0 top
R16324  10K  [0201]  124.1,76.25 0 top
R16325  10K  [0201]  124.1,76.86 0 top
R16326  10K  [0201]  124.1,77.47 0 top
R16327  10K  [0201]  124.1,78.08 0 top
R16328  10K  [0201]  124.1,78.69 0 top
R16329  10K  [0201]  124.1,79.3 0 top
R16330  10K  [0201]  124.1,79.91 0 top
R16331  10K  [0201]  124.1,80.52 0 top
R16332  10K  [0201]  124.1,81.13 0 top
R16333  10K  [0201]  124.1,81.74 0 top
R16334  10K  [0201]  124.1,82.35 0 top
R16335  10K  [0201]  124.1,82.96 0 top
R16336  10K  [0201]  124.1,83.57 0 top
R16337  10K  [0201]  124.1,84.18 0 top
R16338  10K  [0201]  124.1,84.79 0 top
R16339  10K  [0201]  124.1,85.39 0 top
R16340  10K  [0201]  124.1,86 0 top
R16341  10K  [0201]  124.1,86.61 0 top
R16342  10K  [0201]  124.1,87.22 0 top
R16343  10K  [0201]  124.1,87.83 0 top
R16344  10K  [0201]  124.1,88.44 0 top
R16345  10K  [0201]  124.1,89.05 0 top
R16346  10K  [0201]  124.1,89.66 0 top
R16347  10K  [0201]  124.1,90.27 0 top
R16348  10K  [0201]  124.1,90.88 0 top
R16349  10K  [0201]  124.1,91.49 0 top
R16350  10K  [0201]  124.1,92.1 0 top
R16351  10K  [0201]  124.1,92.71 0 top
R16352  10K  [0201]  124.1,93.32 0 top
R16353  10K  [0201]  124.1,93.93 0 top
R16354  10K  [0201]  124.1,94.54 0 top
R16355  10K  [0201]  124.1,95.15 0 top
R16356  10K  [0201]  124.1,95.76 0 top
R16357  10K  [0201]  124.1,96.37 0 top
R16358  10K  [0201]  124.1,96.98 0 top
R16359  10K  [0201]  124.1,97.59 0 top
R16360  10K  [0201]  124.1,98.2 0 top
R16361  10K  [0201]  124.1,98.81 0 top
R16362  10K  [0201]  124.1,99.42 0 top
R16363  10K  [0201]  124.1,100.03 0 top
R16364  10K  [0201]  124.1,100.63 0 top
R16365  10K  [0201]  124.1,101.24 0 top
R16366  10K  [0201]  124.1,101.85 0 top
R16367  10K  [0201]  124.1,102.46 0 top
R16368  10K  [0201]  124.1,103.07 0 top
R16369  10K  [0201]  124.1,103.68 0 top
R16370  10K  [0201]  124.1,104.29 0 top
R16371  10K  [0201]  124.1,104.9 0 top
R16372  10K  [0201]  124.1,105.51 0 top
R16373  10K  [0201]  124.1,106.12 0 top
R16374  10K  [0201]  124.1,106.73 0 top
R16375  10K  [0201]  124.1,107.34 0 top
R16376  10K  [0201]  124.1,107.95 0 top
R16377  10K  [0201]  124.1,108.56 0 top
R16378  10K  [0201]  124.1,109.17 0 top
R16379  10K  [0201]  124.1,109.78 0 top
R16380  10K  [0201]  124.1,110.39 0 top
R16381  10K  [0201]  124.1,111 0 top
R16382  10K  [0201]  124.1,111.61 0 top
R16383  10K  [0201]  124.1,112.22 0 top
R16384  10K  [0201]  124.1,112.83 0 top
R16385  10K  [0201]  124.1,113.44 0 top
R16386  10K  [0201]  124.1,114.05 0 top
R16387  10K  [0201]  124.1,114.66 0 top
R16388  10K  [0201]  124.1,115.27 0 top
R16389  10K  [0201]  124.1,115.87 0 top
R16390  10K  [0201]  124.1,116.48 0 top
R16391  10K  [0201]  124.1,117.09 0 top
R16392  10K  [0201]  124.1,117.7 0 top
R16393  10K  [0201]  124.1,118.31 0 top
R16394  10K  [0201]  124.1,118.92 0 top
R16395  10K  [0201]  124.1,119.53 0 top
R16396  10K  [0201]  124.1,120.14 0 top
R16397  10K  [0201]  124.1,120.75 0 top
R16398  10K  [0201]  124.1,121.36 0 top
R16399  10K  [0201]  124.1,121.97 0 top
R16400  10K  [0201]  124.1,122.58 0 top
R16401  10K  [0201]  125.32,1.27 0 top
R16402  10K  [0201]  125.32,1.88 0 top
R16403  10K  [0201]  125.32,2.49 0 top
R16404  10K  [0201]  125.32,3.1 0 top
R16405  10K  [0201]  125.32,3.71 0 top
R16406  10K  [0201]  125.32,4.32 0 top
R16407  10K  [0201]  125.32,4.93 0 top
R16408  10K  [0201]  125.32,5.54 0 top
R16409  10K  [0201]  125.32,6.15 0 top
R16410  10K  [0201]  125.32,6.76 0 top
R16411  10K  [0201]  125.32,7.37 0 top
R16412  10K  [0201]  125.32,7.98 0 top
R16413  10K  [0201]  125.32,8.59 0 top
R16414  10K  [0201]  125.32,9.19 0 top
R16415  10K  [0201]  125.32,9.8 0 top
R16416  10K  [0201]  125.32,10.41 0 top
R16417  10K  [0201]  125.32,11.02 0 top
R16418  10K  [0201]  125.32,11.63 0 top
R16419  10K  [0201]  125.32,12.24 0 top
R16420  10K  [0201]  125.32,12.85 0 top
R16421  10K  [0201]  125.32,13.46 0 top
R16422  10K  [0201]  125.32,14.07 0 top
R16423  10K  [0201]  125.32,14.68 0 top
R16424  10K  [0201]  125.32,15.29 0 top
R16425  10K  [0201]  125.32,15.9 0 top
R16426  10K  [0201]  125.32,16.51 0 top
R16427  10K  [0201]  125.32,17.12 0 top
R16428  10K  [0201]  125.32,17.73 0 top
R16429  10K  [0201]  125.32,18.34 0 top
R16430  10K  [0201]  125.32,18.95 0 top
R16431  10K  [0201]  125.32,19.56 0 top
R16432  10K  [0201]  125.32,20.17 0 top
R16433  10K  [0201]  125.32,20.78 0 top
R16434  10K  [0201]  125.32,21.39 0 top
R16435  10K  [0201]  125.32,22 0 top
R16436  10K  [0201]  125.32,22.61 0 top
R16437  10K  [0201]  125.32,23.22 0 top
R16438  10K  [0201]  125.32,23.83 0 top
R16439  10K  [0201]  125.32,24.43 0 top
R16440  10K  [0201]  125.32,25.04 0 top
R16441  10K  [0201]  125.32,25.65 0 top
R16442  10K  [0201]  125.32,26.26 0 top
R16443  10K  [0201]  125.32,26.87 0 top
R16444  10K  [0201]  125.32,27.48 0 top
R16445  10K  [0201]  125.32,28.09 0 top
R16446  10K  [0201]  125.32,28.7 0 top
R16447  10K  [0201]  125.32,29.31 0 top
R16448  10K  [0201]  125.32,29.92 0 top
R16449  10K  [0201]  125.32,30.53 0 top
R16450  10K  [0201]  125.32,31.14 0 top
R16451  10K  [0201]  125.32,31.75 0 top
R16452  10K  [0201]  125.32,32.36 0 top
R16453  10K  [0201]  125.32,32.97 0 top
R16454  10K  [0201]  125.32,33.58 0 top
R16455  10K  [0201]  125.32,34.19 0 top
R16456  10K  [0201]  125.32,34.8 0 top
R16457  10K  [0201]  125.32,35.41 0 top
R16458  10K  [0201]  125.32,36.02 0 top
R16459  10K  [0201]  125.32,36.63 0 top
R16460  10K  [0201]  125.32,37.24 0 top
R16461  10K  [0201]  125.32,37.85 0 top
R16462  10K  [0201]  125.32,38.46 0 top
R16463  10K  [0201]  125.32,39.07 0 top
R16464  10K  [0201]  125.32,39.67 0 top
R16465  10K  [0201]  125.32,40.28 0 top
R16466  10K  [0201]  125.32,40.89 0 top
R16467  10K  [0201]  125.32,41.5 0 top
R16468  10K  [0201]  125.32,42.11 0 top
R16469  10K  [0201]  125.32,42.72 0 top
R16470  10K  [0201]  125.32,43.33 0 top
R16471  10K  [0201]  125.32,43.94 0 top
R16472  10K  [0201]  125.32,44.55 0 top
R16473  10K  [0201]  125.32,45.16 0 top
R16474  10K  [0201]  125.32,45.77 0 top
R16475  10K  [0201]  125.32,46.38 0 top
R16476  10K  [0201]  125.32,46.99 0 top
R16477  10K  [0201]  125.32,47.6 0 top
R16478  10K  [0201]  125.32,48.21 0 top
R16479  10K  [0201]  125.32,48.82 0 top
R16480  10K  [0201]  125.32,49.43 0 top
R16481  10K  [0201]  125.32,50.04 0 top
R16482  10K  [0201]  125.32,50.65 0 top
R16483  10K  [0201]  125.32,51.26 0 top
R16484  10K  [0201]  125.32,51.87 0 top
R16485  10K  [0201]  125.32,52.48 0 top
R16486  10K  [0201]  125.32,53.09 0 top
R16487  10K  [0201]  125.32,53.7 0 top
R16488  10K  [0201]  125.32,54.31 0 top
R16489  10K  [0201]  125.32,54.91 0 top
R16490  10K  [0201]  125.32,55.52 0 top
R16491  10K  [0201]  125.32,56.13 0 top
R16492  10K  [0201]  125.32,56.74 0 top
R16493  10K  [0201]  125.32,57.35 0 top
R16494  10K  [0201]  125.32,57.96 0 top
R16495  10K  [0201]  125.32,58.57 0 top
R16496  10K  [0201]  125.32,59.18 0 top
R16497  10K  [0201]  125.32,59.79 0 top
R16498  10K  [0201]  125.32,60.4 0 top
R16499  10K  [0201]  125.32,61.01 0 top
R16500  10K  [0201]  125.32,61.62 0 top
R16501  10K  [0201]  125.32,62.23 0 top
R16502  10K  [0201]  125.32,62.84 0 top
R16503  10K  [0201]  125.32,63.45 0 top
R16504  10K  [0201]  125.32,64.06 0 top
R16505  10K  [0201]  125.32,64.67 0 top
R16506  10K  [0201]  125.32,65.28 0 top
R16507  10K  [0201]  125.32,65.89 0 top
R16508  10K  [0201]  125.32,66.5 0 top
R16509  10K  [0201]  125.32,67.11 0 top
R16510  10K  [0201]  125.32,67.72 0 top
R16511  10K  [0201]  125.32,68.33 0 top
R16512  10K  [0201]  125.32,68.94 0 top
R16513  10K  [0201]  125.32,69.55 0 top
R16514  10K  [0201]  125.32,70.15 0 top
R16515  10K  [0201]  125.32,70.76 0 top
R16516  10K  [0201]  125.32,71.37 0 top
R16517  10K  [0201]  125.32,71.98 0 top
R16518  10K  [0201]  125.32,72.59 0 top
R16519  10K  [0201]  125.32,73.2 0 top
R16520  10K  [0201]  125.32,73.81 0 top
R16521  10K  [0201]  125.32,74.42 0 top
R16522  10K  [0201]  125.32,75.03 0 top
R16523  10K  [0201]  125.32,75.64 0 top
R16524  10K  [0201]  125.32,76.25 0 top
R16525  10K  [0201]  125.32,76.86 0 top
R16526  10K  [0201]  125.32,77.47 0 top
R16527  10K  [0201]  125.32,78.08 0 top
R16528  10K  [0201]  125.32,78.69 0 top
R16529  10K  [0201]  125.32,79.3 0 top
R16530  10K  [0201]  125.32,79.91 0 top
R16531  10K  [0201]  125.32,80.52 0 top
R16532  10K  [0201]  125.32,81.13 0 top
R16533  10K  [0201]  125.32,81.74 0 top
R16534  10K  [0201]  125.32,82.35 0 top
R16535  10K  [0201]  125.32,82.96 0 top
R16536  10K  [0201]  125.32,83.57 0 top
R16537  10K  [0201]  125.32,84.18 0 top
R16538  10K  [0201]  125.32,84.79 0 top
R16539  10K  [0201]  125.32,85.39 0 top
R16540  10K  [0201]  125.32,86 0 top
R16541  10K  [0201]  125.32,86.61 0 top
R16542  10K  [0201]  125.32,87.22 0 top
R16543  10K  [0201]  125.32,87.83 0 top
R16544  10K  [0201]  125.32,88.44 0 top
R16545  10K  [0201]  125.32,89.05 0 top
R16546  10K  [0201]  125.32,89.66 0 top
R16547  10K  [0201]  125.32,90.27 0 top
R16548  10K  [0201]  125.32,90.88 0 top
R16549  10K  [0201]  125.32,91.49 0 top
R16550  10K  [0201]  125.32,92.1 0 top
R16551  10K  [0201]  125.32,92.71 0 top
R16552  10K  [0201]  125.32,93.32 0 top
R16553  10K  [0201]  125.32,93.93 0 top
R16554  10K  [0201]  125.32,94.54 0 top
R16555  10K  [0201]  125.32,95.15 0 top
R16556  10K  [0201]  125.32,95.76 0 top
R16557  10K  [0201]  125.32,96.37 0 top
R16558  10K  [0201]  125.32,96.98 0 top
R16559  10K  [0201]  125.32,97.59 0 top
R16560  10K  [0201]  125.32,98.2 0 top
R16561  10K  [0201]  125.32,98.81 0 top
R16562  10K  [0201]  125.32,99.42 0 top
R16563  10K  [0201]  125.32,100.03 0 top
R16564  10K  [0201]  125.32,100.63 0 top
R16565  10K  [0201]  125.32,101.24 0 top
R16566  10K  [0201]  125.32,101.85 0 top
R16567  10K  [0201]  125.32,102.46 0 top
R16568  10K  [0201]  125.32,103.07 0 top
R16569  10K  [0201]  125.32,103.68 0 top
R16570  10K  [0201]  125.32,104.29 0 top
R16571  10K  [0201]  125.32,104.9 0 top
R16572  10K  [0201]  125.32,105.51 0 top
R16573  10K  [0201]  125.32,106.12 0 top
R16574  10K  [0201]  125.32,106.73 0 top
R16575  10K  [0201]  125.32,107.34 0 top
R16576  10K  [0201]  125.32,107.95 0 top
R16577  10K  [0201]  125.32,108.56 0 top
R16578  10K  [0201]  125.32,109.17 0 top
R16579  10K  [0201]  125.32,109.78 0 top
R16580  10K  [0201]  125.32,110.39 0 top
R16581  10K  [0201]  125.32,111 0 top
R16582  10K  [0201]  125.32,111.61 0 top
R16583  10K  [0201]  125.32,112.22 0 top
R16584  10K  [0201]  125.32,112.83 0 top
R16585  10K  [0201]  125.32,113.44 0 top
R16586  10K  [0201]  125.32,114.05 0 top
R16587  10K  [0201]  125.32,114.66 0 top
R16588  10K  [0201]  125.32,115.27 0 top
R16589  10K  [0201]  125.32,115.87 0 top
R16590  10K  [0201]  125.32,116.48 0 top
R16591  10K  [0201]  125.32,117.09 0 top
R16592  10K  [0201]  125.32,117.7 0 top
R16593  10K  [0201]  125.32,118.31 0 top
R16594  10K  [0201]  125.32,118.92 0 top
R16595  10K  [0201]  125.32,119.53 0 top
R16596  10K  [0201]  125.32,120.14 0 top
R16597  10K  [0201]  125.32,120.75 0 top
R16598  10K  [0201]  125.32,121.36 0 top
R16599  10K  [0201]  125.32,121.97 0 top
R16600  10K  [0201]  125.32,122.58 0 top
R16601  10K  [0201]  126.54,1.27 0 top
R16602  10K  [0201]  126.54,1.88 0 top
R16603  10K  [0201]  126.54,2.49 0 top
R16604  10K  [0201]  126.54,3.1 0 top
R16605  10K  [0201]  126.54,3.71 0 top
R16606  10K  [0201]  126.54,4.32 0 top
R16607  10K  [0201]  126.54,4.93 0 top
R16608  10K  [0201]  126.54,5.54 0 top
R16609  10K  [0201]  126.54,6.15 0 top
R16610  10K  [0201]  126.54,6.76 0 top
R16611  10K  [0201]  126.54,7.37 0 top
R16612  10K  [0201]  126.54,7.98 0 top
R16613  10K  [0201]  126.54,8.59 0 top
R16614  10K  [0201]  126.54,9.19 0 top
R16615  10K  [0201]  126.54,9.8 0 top
R16616  10K  [0201]  126.54,10.41 0 top
R16617  10K  [0201]  126.54,11.02 0 top
R16618  10K  [0201]  126.54,11.63 0 top
R16619  10K  [0201]  126.54,12.24 0 top
R16620  10K  [0201]  126.54,12.85 0 top
R16621  10K  [0201]  126.54,13.46 0 top
R16622  10K  [0201]  126.54,14.07 0 top
R16623  10K  [0201]  126.54,14.68 0 top
R16624  10K  [0201]  126.54,15.29 0 top
R16625  10K  [0201]  126.54,15.9 0 top
R16626  10K  [0201]  126.54,16.51 0 top
R16627  10K  [0201]  126.54,17.12 0 top
R16628  10K  [0201]  126.54,17.73 0 top
R16629  10K  [0201]  126.54,18.34 0 top
R16630  10K  [0201]  126.54,18.95 0 top
R16631  10K  [0201]  126.54,19.56 0 top
R16632  10K  [0201]  126.54,20.17 0 top
R16633  10K  [0201]  126.54,20.78 0 top
R16634  10K  [0201]  126.54,21.39 0 top
R16635  10K  [0201]  126.54,22 0 top
R16636  10K  [0201]  126.54,22.61 0 top
R16637  10K  [0201]  126.54,23.22 0 top
R16638  10K  [0201]  126.54,23.83 0 top
R16639  10K  [0201]  126.54,24.43 0 top
R16640  10K  [0201]  126.54,25.04 0 top
R16641  10K  [0201]  126.54,25.65 0 top
R16642  10K  [0201]  126.54,26.26 0 top
R16643  10K  [0201]  126.54,26.87 0 top
R16644  10K  [0201]  126.54,27.48 0 top
R16645  10K  [0201]  126.54,28.09 0 top
R16646  10K  [0201]  126.54,28.7 0 top
R16647  10K  [0201]  126.54,29.31 0 top
R16648  10K  [0201]  126.54,29.92 0 top
R16649  10K  [0201]  126.54,30.53 0 top
R16650  10K  [0201]  126.54,31.14 0 top
R16651  10K  [0201]  126.54,31.75 0 top
R16652  10K  [0201]  126.54,32.36 0 top
R16653  10K  [0201]  126.54,32.97 0 top
R16654  10K  [0201]  126.54,33.58 0 top
R16655  10K  [0201]  126.54,34.19 0 top
R16656  10K  [0201]  126.54,34.8 0 top
R16657  10K  [0201]  126.54,35.41 0 top
R16658  10K  [0201]  126.54,36.02 0 top
R16659  10K  [0201]  126.54,36.63 0 top
R16660  10K  [0201]  126.54,37.24 0 top
R16661  10K  [0201]  126.54,37.85 0 top
R16662  10K  [0201]  126.54,38.46 0 top
R16663  10K  [0201]  126.54,39.07 0 top
R16664  10K  [0201]  126.54,39.67 0 top
R16665  10K  [0201]  126.54,40.28 0 top
R16666  10K  [0201]  126.54,40.89 0 top
R16667  10K  [0201]  126.54,41.5 0 top
R16668  10K  [0201]  126.54,42.11 0 top
R16669  10K  [0201]  126.54,42.72 0 top
R16670  10K  [0201]  126.54,43.33 0 top
R16671  10K  [0201]  126.54,43.94 0 top
R16672  10K  [0201]  126.54,44.55 0 top
R16673  10K  [0201]  126.54,45.16 0 top
R16674  10K  [0201]  126.54,45.77 0 top
R16675  10K  [0201]  126.54,46.38 0 top
R16676  10K  [0201]  126.54,46.99 0 top
R16677  10K  [0201]  126.54,47.6 0 top
R16678  10K  [0201]  126.54,48.21 0 top
R16679  10K  [0201]  126.54,48.82 0 top
R16680  10K  [0201]  126.54,49.43 0 top
R16681  10K  [0201]  126.54,50.04 0 top
R16682  10K  [0201]  126.54,50.65 0 top
R16683  10K  [0201]  126.54,51.26 0 top
R16684  10K  [0201]  126.54,51.87 0 top
R16685  10K  [0201]  126.54,52.48 0 top
R16686  10K  [0201]  126.54,53.09 0 top
R16687  10K  [0201]  126.54,53.7 0 top
R16688  10K  [0201]  126.54,54.31 0 top
R16689  10K  [0201]  126.54,54.91 0 top
R16690  10K  [0201]  126.54,55.52 0 top
R16691  10K  [0201]  126.54,56.13 0 top
R16692  10K  [0201]  126.54,56.74 0 top
R16693  10K  [0201]  126.54,57.35 0 top
R16694  10K  [0201]  126.54,57.96 0 top
R16695  10K  [0201]  126.54,58.57 0 top
R16696  10K  [0201]  126.54,59.18 0 top
R16697  10K  [0201]  126.54,59.79 0 top
R16698  10K  [0201]  126.54,60.4 0 top
R16699  10K  [0201]  126.54,61.01 0 top
R16700  10K  [0201]  126.54,61.62 0 top
R16701  10K  [0201]  126.54,62.23 0 top
R16702  10K  [0201]  126.54,62.84 0 top
R16703  10K  [0201]  126.54,63.45 0 top
R16704  10K  [0201]  126.54,64.06 0 top
R16705  10K  [0201]  126.54,64.67 0 top
R16706  10K  [0201]  126.54,65.28 0 top
R16707  10K  [0201]  126.54,65.89 0 top
R16708  10K  [0201]  126.54,66.5 0 top
R16709  10K  [0201]  126.54,67.11 0 top
R16710  10K  [0201]  126.54,67.72 0 top
R16711  10K  [0201]  126.54,68.33 0 top
R16712  10K  [0201]  126.54,68.94 0 top
R16713  10K  [0201]  126.54,69.55 0 top
R16714  10K  [0201]  126.54,70.15 0 top
R16715  10K  [0201]  126.54,70.76 0 top
R16716  10K  [0201]  126.54,71.37 0 top
R16717  10K  [0201]  126.54,71.98 0 top
R16718  10K  [0201]  126.54,72.59 0 top
R16719  10K  [0201]  126.54,73.2 0 top
R16720  10K  [0201]  126.54,73.81 0 top
R16721  10K  [0201]  126.54,74.42 0 top
R16722  10K  [0201]  126.54,75.03 0 top
R16723  10K  [0201]  126.54,75.64 0 top
R16724  10K  [0201]  126.54,76.25 0 top
R16725  10K  [0201]  126.54,76.86 0 top
R16726  10K  [0201]  126.54,77.47 0 top
R16727  10K  [0201]  126.54,78.08 0 top
R16728  10K  [0201]  126.54,78.69 0 top
R16729  10K  [0201]  126.54,79.3 0 top
R16730  10K  [0201]  126.54,79.91 0 top
R16731  10K  [0201]  126.54,80.52 0 top
R16732  10K  [0201]  126.54,81.13 0 top
R16733  10K  [0201]  126.54,81.74 0 top
R16734  10K  [0201]  126.54,82.35 0 top
R16735  10K  [0201]  126.54,82.96 0 top
R16736  10K  [0201]  126.54,83.57 0 top
R16737  10K  [0201]  126.54,84.18 0 top
R16738  10K  [0201]  126.54,84.79 0 top
R16739  10K  [0201]  126.54,85.39 0 top
R16740  10K  [0201]  126.54,86 0 top
R16741  10K  [0201]  126.54,86.61 0 top
R16742  10K  [0201]  126.54,87.22 0 top
R16743  10K  [0201]  126.54,87.83 0 top
R16744  10K  [0201]  126.54,88.44 0 top
R16745  10K  [0201]  126.54,89.05 0 top